# EasyEDA Pro project 嵌入式.eprj, board 5V电源板
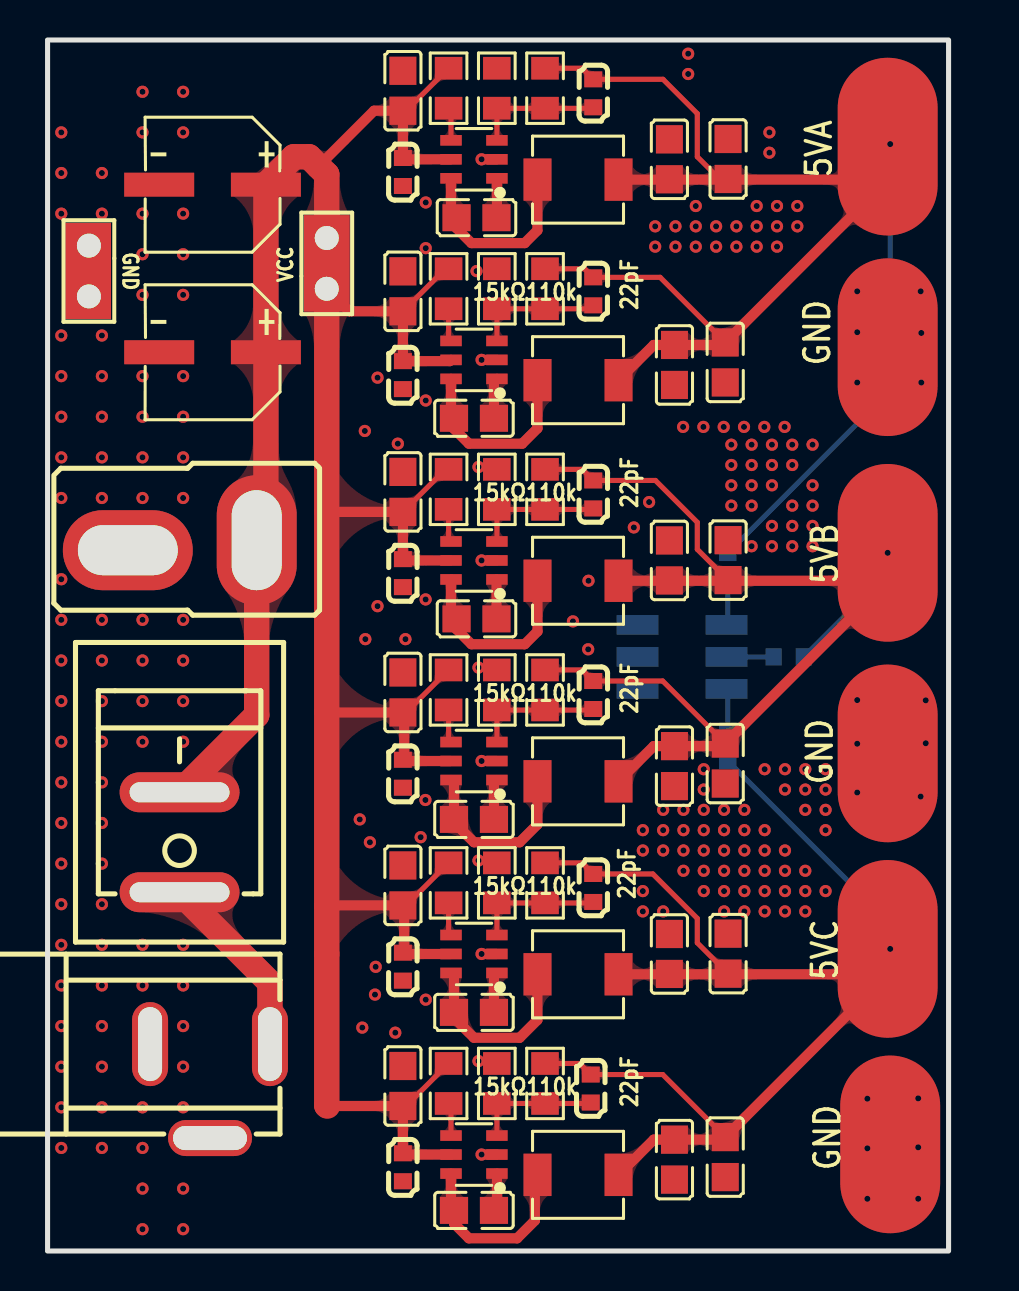
[diagram p12: board, top side]
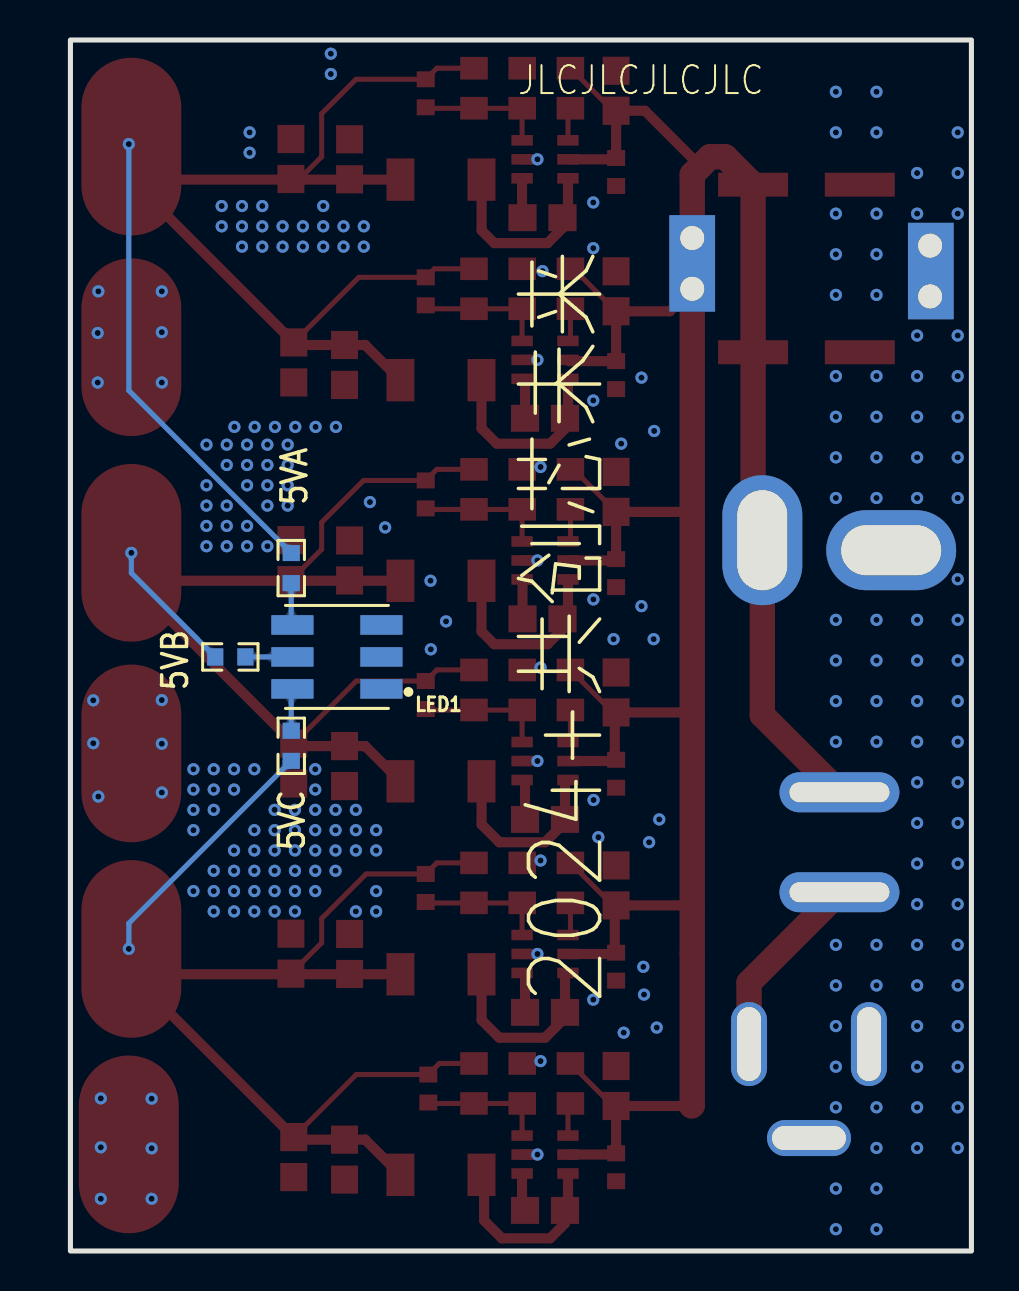
[diagram p13: board, bottom side, seen from below]

Outline 45.08 x 60.58 mm; copper layers: Top Layer, Bottom Layer. Coordinates in mm from the lower left corner of the outline.
Outline path: rectangle 0,60.58 45.08,0
Stack: Top Layer 0.035mm / Dielectric1 1.51mm FR4 er 4.5 / Bottom Layer 0.035mm

## Design rules (mm)
template: 自定义配置
spacing copperThickness1oz (default): track to track 0.102, other pairs 0.152 to 0.3
spacing copperThickness2oz: track to track 0.203, other pairs 0.152 to 0.3
track width copperThickness1oz (default): min 0.127, default 0.254, max 2.54
track width copperThickness2oz: min 0.203, default 0.254, max 2.54
differential pair differentialPair (default): width min 0.127, default 0.254, max 2.54; gap min 0.152, default 0.152
via viaSize (default): diameter min 0.5, default 0.61, max 10; hole min 0.3, default 0.305, max 6.3

## Placement (name value [footprint] x y rotation side)
C1  220uF  [CAP-SMD_BD6.3-L6.6-W6.6-FD]  8.26 44.96 180 top
C1#2  -  [CAP-SMD_BD6.3-L6.6-W6.6-FD]  8.26 53.34 180 top
C2  100nF  [C0603]  17.78 23.88 90 top
C2#2  -  [C0603]  17.78 33.91 90 top
C2#3  -  [C0603]  17.78 4.19 90 top
C2#4  -  [C0603]  17.78 14.22 90 top
C2#5  -  [C0603]  17.78 53.97 90 top
C2#6  -  [C0603]  17.78 43.81 90 top
C3  10uF  [C0805]  17.78 8.25 270 top
C3#2  -  [C0805]  17.78 27.94 270 top
C3#3  -  [C0805]  17.78 37.97 270 top
C3#4  -  [C0805]  17.78 18.29 270 top
C3#5  -  [C0805]  17.78 58.04 270 top
C3#6  -  [C0805]  17.78 48.01 270 top
C4  22uF  [C0805]  31.37 44.32 270 top
C4#2  -  [C0805]  31.37 24.26 270 top
C4#3  -  [C0805]  31.11 34.54 90 top
C4#4  -  [C0805]  31.11 54.61 90 top
C4#5  -  [C0805]  31.37 4.57 270 top
C4#6  -  [C0805]  31.11 14.86 90 top
C5  22uF  [C0805]  33.91 44.45 270 top
C5#2  -  [C0805]  33.91 24.38 270 top
C5#3  -  [C0805]  34.05 34.56 90 top
C5#4  -  [C0805]  34.05 54.63 90 top
C5#5  -  [C0805]  33.91 4.7 270 top
C5#6  -  [C0805]  34.05 14.87 90 top
C6  22pF  [C0603]  27.3 37.85 270 top
C6#2  -  [C0603]  27.3 27.81 270 top
C6#3  -  [C0603]  27.3 57.91 270 top
C6#4  -  [C0603]  27.18 8.13 270 top
C6#5  -  [C0603]  27.3 18.16 270 top
C6#6  -  [C0603]  27.3 48.01 270 top
C33  22nF  [C0805]  21.34 21.59 0 top
C33#2  -  [C0805]  21.46 31.62 0 top
C33#3  -  [C0805]  21.34 2.03 0 top
C33#4  -  [C0805]  21.34 11.94 0 top
C33#5  -  [C0805]  21.46 51.69 0 top
C33#6  -  [C0805]  21.34 41.66 0 top
CN1  AM-1015B-F  [CONN-TH_AM-1015B-F]  7.24 35.31 90 top
DC1  DC-005-2.5A-2.0  [CONN-TH_DC-005-2.5A-2.0]  8.13 8 0 top
H1  PZ254V-11-02P  [HDR-TH_2P-P2.54-V-M]  13.97 49.4 90 top
H1#2  -  [HDR-TH_2P-P2.54-V-M]  2.07 49.02 270 top
L1  4.7uH  [IND-SMD_L4.4-W4.2]  26.54 33.53 180 top
L1#2  -  [IND-SMD_L4.4-W4.2]  26.54 23.49 180 top
L1#3  -  [IND-SMD_L4.4-W4.2]  26.54 3.81 180 top
L1#4  -  [IND-SMD_L4.4-W4.2]  26.54 13.84 180 top
L1#5  -  [IND-SMD_L4.4-W4.2]  26.54 53.59 180 top
L1#6  -  [IND-SMD_L4.4-W4.2]  26.54 43.56 180 top
LED1  XL-5050RGBC  [LED-ARRAY-SMD_6P-L5.0-W5.0-TL-RD_3]  31.75 29.72 0 bottom
NOREF  -  [Pad_e655]  2.03 49.02 90 top
NOREF#2  -  [Pad_e166]  42.04 45.21 270 top
NOREF#3  -  [Pad_e651]  13.97 49.4 90 top
NOREF#4  -  [Pad_e168]  42.04 24.89 270 top
NOREF#5  -  [Pad_e169]  42.04 15.11 270 top
NOREF#6  -  [Pad_e170]  42.16 5.33 270 top
NOREF#7  -  [Pad_e654]  13.97 49.4 90 top
NOREF#8  -  [Pad_e167]  42.04 34.92 270 top
NOREF#9  -  [Pad_e164]  42.04 55.24 270 top
NOREF#10  -  [Pad_e653]  2.03 49.02 90 top
R1  0  [R0805]  20.07 38.1 270 top
R1#2  -  [R0805]  20.07 28.07 270 top
R1#3  -  [R0805]  20.07 18.41 270 top
R1#4  -  [R0805]  20.07 8.38 270 top
R1#5  -  [R0805]  20.07 58.17 270 top
R1#6  -  [R0805]  20.07 48.13 270 top
R2  15kΩ  [R0805]  22.48 58.17 90 top
R2#2  -  [R0805]  22.48 28.07 90 top
R2#3  -  [R0805]  22.48 38.1 90 top
R2#4  -  [R0805]  22.48 8.38 90 top
R2#5  -  [R0805]  22.48 18.41 90 top
R2#6  -  [R0805]  22.48 48.13 90 top
R3  110k  [R0805]  24.89 38.1 270 top
R3#2  -  [R0805]  24.89 58.17 270 top
R3#3  -  [R0805]  24.89 28.07 270 top
R3#4  -  [R0805]  24.89 8.38 270 top
R3#5  -  [R0805]  24.89 18.41 270 top
R3#6  -  [R0805]  24.89 48.13 270 top
R19  1kΩ  [R0603]  34.04 34.16 270 bottom
R20  1kΩ  [R0603]  37.08 29.72 180 bottom
R21  1kΩ  [R0603]  34.04 25.27 90 bottom
SW1  RS601HL-1010011BB  [SW-TH_RS601HL-1010011BB]  6.6 20.45 90 top
U1  MT2492  [SOT-23-6_L2.9-W1.6-P0.95-LS2.8-BL]  21.34 54.61 90 top
U1#2  -  [SOT-23-6_L2.9-W1.6-P0.95-LS2.8-BL]  21.34 24.51 90 top
U1#3  -  [SOT-23-6_L2.9-W1.6-P0.95-LS2.8-BL]  21.34 34.54 90 top
U1#4  -  [SOT-23-6_L2.9-W1.6-P0.95-LS2.8-BL]  21.34 4.83 90 top
U1#5  -  [SOT-23-6_L2.9-W1.6-P0.95-LS2.8-BL]  21.34 14.86 90 top
U1#6  -  [SOT-23-6_L2.9-W1.6-P0.95-LS2.8-BL]  21.34 44.58 90 top

## Footprints (pads in the part's own frame, mm; a bottom-side part is the same pattern mirrored in y, then rotated)
C0603
  rect 0.8x0.9 smd: 1(-0.7,0) 2(0.7,0)
C0805
  rect 1.41x1.35 smd: 1(-1,0) 2(1,0)
CAP-SMD_BD6.3-L6.6-W6.6-FD
  rect 3.5x1.2 smd: 1(-2.67,0) 2(2.67,0)
CONN-TH_AM-1015B-F
  oval 4x6.5 hole 2.5x5: 1(-0.25,3.224)
  oval 6.5x4 hole 5x2.5: 2(0.25,-3.224)
CONN-TH_DC-005-2.5A-2.0
  oval 1.8x4.2 hole 1.2x3.7: 1(2.999,2.35) 2(-2.999,2.35)
  oval 4.2x1.8 hole 3.7x1.2: 3(0,-2.35)
HDR-TH_2P-P2.54-V-M
  rect 2x2 hole 1.2: 1(-1.27,0)
  round 2 hole 1.2: 2(1.27,0)
IND-SMD_L4.4-W4.2
  rect 1.4x2.12 smd: 1(2.028,0) 2(-2.028,0)
LED-ARRAY-SMD_6P-L5.0-W5.0-TL-RD_3
  rect 2.105x0.98 smd: 1(-2.228,1.6) 2(-2.228,0) 3(-2.228,-1.6) 4(2.228,-1.6) 5(2.228,0) 6(2.228,1.6)
Pad_e164
  oval 8.89x5 smd: 7(0,0)
Pad_e166
  oval 8.89x5 smd: 7(0,0)
Pad_e167
  oval 8.89x5 smd: 7(0,0)
Pad_e168
  oval 8.89x5 smd: 7(0,0)
Pad_e169
  oval 8.89x5 smd: 7(0,0)
Pad_e170
  oval 8.89x5 smd: 7(0,0)
Pad_e651
  rect 4.826x2.286 smd: 7(0,0)
Pad_e653
  rect 4.826x2.286 smd: 7(0,0)
Pad_e654
  rect 4.826x2.286 smd far side: 7(0,0)
Pad_e655
  rect 4.826x2.286 smd far side: 7(0,0)
R0603
  rect 0.806x0.864 smd: 1(-0.753,0) 2(0.753,0)
R0805
  rect 1.133x1.377 smd: 1(-1,0) 2(1,0)
SOT-23-6_L2.9-W1.6-P0.95-LS2.8-BL
  rect 0.532x1.072 smd: 1(-0.95,-1.149) 2(0,-1.149) 3(0.95,-1.149) 4(0.95,1.149) 5(0,1.149) 6(-0.95,1.149)
SW-TH_RS601HL-1010011BB
  oval 2x6 hole 1x5: 1(-2.5,0) 2(2.5,0)

## Nets
5VA: C4.1 C4#2.1 C4#3.1 C4#4.1 C4#5.1 C4#6.1 C5.1 C5#2.1 C5#3.1 C5#4.1 C5#5.1 C5#6.1 C6.1 C6#2.1 C6#3.1 C6#4.1 C6#5.1 C6#6.1 L1.2 L1#2.2 L1#3.2 L1#4.2 L1#5.2 L1#6.2 NOREF#5.7 NOREF#8.7 NOREF#9.7 R3.1 R3#2.1 R3#3.1 R3#4.1 R3#5.1 R3#6.1 R19.1 R20.1 R21.1
GND: C1.2 C1#2.2 C2.1 C2#2.1 C2#3.1 C2#4.1 C2#5.1 C2#6.1 C3.1 C3#2.1 C3#3.1 C3#4.1 C3#5.1 C3#6.1 C4.2 C4#2.2 C4#3.2 C4#4.2 C4#5.2 C4#6.2 C5.2 C5#2.2 C5#3.2 C5#4.2 C5#5.2 C5#6.2 CN1.1 DC1.2 DC1.3 H1#2.1 H1#2.2 LED1.1 LED1.2 LED1.3 NOREF.7 NOREF#2.7 NOREF#4.7 NOREF#6.7 NOREF#10.7 R2.2 R2#2.2 R2#3.2 R2#4.2 R2#5.2 R2#6.2 U1.2 U1#2.2 U1#3.2 U1#4.2 U1#5.2 U1#6.2
VCC: C1.1 C1#2.1 C2.2 C2#2.2 C2#3.2 C2#4.2 C2#5.2 C2#6.2 C3.2 C3#2.2 C3#3.2 C3#4.2 C3#5.2 C3#6.2 CN1.2 H1.1 H1.2 NOREF#3.7 NOREF#7.7 R1.1 R1#2.1 R1#3.1 R1#4.1 R1#5.1 R1#6.1 SW1.2 U1.5 U1#2.5 U1#3.5 U1#4.5 U1#5.5 U1#6.5
PWER: DC1.1 SW1.1
$1N570: R1.2 R1#2.2 R1#3.2 R1#4.2 R1#5.2 R1#6.2 U1.4 U1#2.4 U1#3.4 U1#4.4 U1#5.4 U1#6.4
$1N904: C33.1 C33#2.1 C33#3.1 C33#4.1 C33#5.1 C33#6.1 L1.1 L1#2.1 L1#3.1 L1#4.1 L1#5.1 L1#6.1 U1.6 U1#2.6 U1#3.6 U1#4.6 U1#5.6 U1#6.6
$1N917: C33.2 C33#2.2 C33#3.2 C33#4.2 C33#5.2 C33#6.2 U1.1 U1#2.1 U1#3.1 U1#4.1 U1#5.1 U1#6.1
$1N1064: C6.2 C6#2.2 C6#3.2 C6#4.2 C6#5.2 C6#6.2 R2.1 R2#2.1 R2#3.1 R2#4.1 R2#5.1 R2#6.1 R3.2 R3#2.2 R3#3.2 R3#4.2 R3#5.2 R3#6.2 U1.3 U1#2.3 U1#3.3 U1#4.3 U1#5.3 U1#6.3
$1N4201: LED1.5 R20.2
$1N4240: LED1.6 R21.2
$1N4279: LED1.4 R19.2

## Via types
v1: diameter 0.61, hole 0.305, Top Layer to Bottom Layer, 246 vias

## Routing (per net, layer and track width the routed paths; a pad name or vN(x,y) marks a point on that pad's centre or on a via; arc(x,y) is an arc through that point)
5VA: length 211.6
  Top Layer w0.254: C5.1 30.65,48.71 C6#6.1 26.88,49.13 R3#6.1 ; R3#2.1 26.75,59.17 C6#3.1 30.8,58.61 32.51,56.9 32.51,54.74 33.62,53.63 C5#4.1 ; C5#2.1 30.78,28.51 C6#2.1 26.75,29.07 R3#3.1 ; C5#3.1 32.51,35.1 32.51,36.45 30.42,38.55 C6.1 26.75,39.1 R3.1 ; R3#4.1 26.62,9.38 C6#4.1 30.78,8.83 C5#5.1 ; C5#6.1 32.51,15.41 32.51,16.64 30.29,18.86 C6#5.1 26.75,19.41 R3#5.1
  Top Layer w0.508: 34.02,53.59 40.39,53.59 NOREF#9.7 42.04,53.58 C5.1 33.78,45.32 C4.1 30.33,45.32 L1#6.2 ; 34.02,53.59 C5#4.1 ; 34.02,53.59 L1#5.2 ; L1.2 40.64,33.53 v1(42.04,34.92) 42.04,33.51 C5#2.1 33.78,25.26 C4#2.1 30.33,25.26 L1#2.2 ; L1#3.2 30.33,5.57 C4#5.1 33.78,5.57 C5#5.1 42.04,13.83 NOREF#5.7 40.77,13.84 L1#4.2
  Bottom Layer w0.254: v1(42.16,55.37) 42.16,43.04 R19.1 ; v1(42.16,15.11) 42.16,16.39 R21.1 ; R20.1 42.04,33.92 42.04,34.8
GND: length 4.6
  Top Layer w0.508: 22.48,14.86 v1(21.72,14.86) ; 22.48,24.51 v1(21.72,24.51) ; U1#3.2 v1(21.72,34.54) ; U1#4.2 v1(21.72,4.83) ; U1#6.2 v1(21.72,44.58) ; U1.2 v1(21.72,54.61)
  vias: v1(0.69,55.96) v1(0.69,53.92) v1(0.69,51.89) v1(0.69,45.8) v1(0.69,43.76) v1(0.69,41.73) v1(0.69,39.7) v1(0.69,37.67) v1(0.69,33.6) v1(0.69,31.57) v1(0.69,29.54) v1(0.69,27.51) v1(0.69,25.48) v1(0.69,23.44) v1(0.69,21.41) v1(0.69,19.38) v1(0.69,17.35) v1(0.69,15.32) v1(0.69,13.28) v1(0.69,11.25) v1(0.69,9.22) v1(0.69,7.19) v1(0.69,5.16) v1(2.72,53.92) v1(2.72,51.89) v1(2.72,45.8) v1(2.72,43.76) v1(2.72,41.73) v1(2.72,39.7) v1(2.72,37.67) v1(2.72,31.57) v1(2.72,29.54) v1(2.72,27.51) v1(2.72,25.48) v1(2.72,23.44) v1(2.72,21.41) v1(2.72,19.38) v1(2.72,17.35) v1(2.72,15.32) v1(2.72,13.28) v1(2.72,11.25) v1(2.72,9.22) v1(2.72,7.19) v1(2.72,5.16) v1(4.75,57.99) v1(4.75,55.96) v1(4.75,51.89) v1(4.75,49.86) v1(4.75,47.83) v1(4.75,43.76) v1(4.75,41.73) v1(4.75,39.7) v1(4.75,37.67) v1(4.75,31.57) v1(4.75,29.54) v1(4.75,27.51) v1(4.75,25.48) v1(4.75,15.32) v1(4.75,13.28) v1(4.75,7.19) v1(4.75,5.16) v1(4.75,3.12) v1(4.75,1.09) v1(6.78,57.99) v1(6.78,55.96) v1(6.78,51.89) v1(6.78,49.86) v1(6.78,47.83) v1(6.78,43.76) v1(6.78,41.73) v1(6.78,39.7) v1(6.78,37.67) v1(6.78,31.57) v1(6.78,29.54) v1(6.78,27.51) v1(6.78,25.48) v1(6.78,15.32) v1(6.78,13.28) v1(6.78,11.25) v1(6.78,9.22) v1(6.78,7.19) v1(6.78,3.12) v1(6.78,1.09) v1(15.62,21.59) v1(15.75,11.18) v1(15.88,41.02) v1(15.9,30.61) v1(16.13,20.45) v1(16.42,14.22) v1(16.38,12.83) v1(16.51,43.69) v1(16.51,32.26) v1(17.4,10.92) v1(17.53,40.39) v1(17.91,30.61) v1(18.67,20.7) v1(18.92,52.45) v1(18.92,50.16) v1(18.92,42.54) v1(18.92,32.59) v1(18.91,22.56) v1(18.92,12.57) v1(21.46,49.02) v1(21.56,39.22) v1(21.56,29.19) v1(21.56,19.53) v1(21.56,9.5) v1(26.29,31.5) v1(27.07,33.53) v1(27.05,30.1) v1(29.34,36.19) v1(29.79,21.05) v1(29.79,20.04) v1(29.79,18) v1(29.79,16.99) v1(30.1,37.46) v1(30.4,51.26) v1(30.4,50.24) v1(30.8,22.07) v1(30.8,21.05) v1(30.8,20.04) v1(30.8,16.99) v1(31.42,51.26) v1(31.42,50.24) v1(31.8,41.22) v1(31.82,22.07) v1(31.82,21.05) v1(31.82,20.04) v1(31.82,19.02) v1(32.05,59.89) v1(32.05,58.88) v1(32.44,52.27) v1(32.44,51.26) v1(32.44,50.24) v1(32.82,41.22) v1(32.83,24.1) v1(32.83,23.08) v1(32.83,22.07) v1(32.83,21.05) v1(32.83,20.04) v1(32.83,19.02) v1(32.83,18) v1(33.45,51.26) v1(33.45,50.24) v1(33.83,41.22) v1(33.85,22.07) v1(33.85,21.05) v1(33.85,20.04) v1(33.85,19.02) v1(33.85,18) v1(33.85,16.99) v1(34.21,40.33) v1(34.21,39.32) v1(34.21,38.3) v1(34.21,37.29) v1(34.47,51.26) v1(34.47,50.24) v1(34.85,41.22) v1(34.87,22.07) v1(34.87,21.05) v1(34.87,20.04) v1(34.87,19.02) v1(34.87,18) v1(34.87,16.99) v1(35.23,40.33) v1(35.23,39.32) v1(35.23,38.3) v1(35.23,37.29) v1(35.23,35.25) v1(35.48,52.27) v1(35.48,51.26) v1(35.48,50.24) v1(35.86,41.22) v1(35.88,24.1) v1(35.88,21.05) v1(35.88,20.04) v1(35.88,19.02) v1(35.88,18) v1(35.88,16.99) v1(36.12,55.96) v1(36.12,54.94) v1(36.25,40.33) v1(36.25,39.32) v1(36.25,38.3) v1(36.25,36.27) v1(36.25,35.25) v1(36.5,52.27) v1(36.5,51.26) v1(36.5,50.24) v1(36.88,41.22) v1(36.9,24.1) v1(36.9,23.08) v1(36.9,20.04) v1(36.9,19.02) v1(36.9,18) v1(36.9,16.99) v1(37.26,40.33) v1(37.26,39.32) v1(37.26,37.29) v1(37.26,36.27) v1(37.26,35.25) v1(37.52,52.27) v1(37.52,51.26) v1(37.91,24.1) v1(37.91,23.08) v1(37.91,22.07) v1(37.91,19.02) v1(37.91,18) v1(37.91,16.99) v1(38.28,40.33) v1(38.28,38.3) v1(38.28,37.29) v1(38.28,36.27) v1(38.28,35.25) v1(38.93,24.1) v1(38.93,23.08) v1(38.93,22.07) v1(38.93,21.05) v1(38.93,18) v1(40.51,48.01) v1(40.51,45.96) v1(40.51,43.44) v1(40.51,27.56) v1(40.51,25.37) v1(40.51,22.93) v1(41.02,7.62) v1(41.02,5.14) v1(41.02,2.61) v1(43.57,7.63) v1(43.57,5.19) v1(43.57,2.61) v1(43.69,48.01) v1(43.72,45.92) v1(43.72,43.44) v1(43.69,22.73) v1(43.94,27.55) v1(43.94,25.4)
VCC: length 155.8
  Top Layer w0.254: C3#5.2 17.94,57.04 R1#5.1 ; R1#3.1 17.94,17.29 C3#4.2 ; R1#6.1 19.91,49.13 C3#6.2 ; C3.2 17.94,7.25 R1#4.1 ; R1.1 19.91,39.1 C3#3.2 ; C3#2.2 17.94,26.94 R1#2.1
  Top Layer w0.508: 14,7.25 C3.2 C2#3.2 17.85,4.83 U1#4.5 ; 17.85,14.86 C2#4.2 ; 17.85,14.86 U1#5.5 ; 17.85,14.86 17.85,17.22 C3#4.2 14,17.29 13.97,17.26 ; 13.98,14.86 13.97,14.86 ; 13.97,36.96 13.99,36.97 C3#3.2 C2#2.2 17.85,34.54 U1#3.5 ; U1#2.5 17.85,24.51 ; 17.85,24.51 17.85,26.87 C3#2.2 13.98,26.94 13.97,26.95 ; 17.85,24.51 C2.2 ; U1.5 17.85,54.61 C2#5.2 C3#5.2 16.33,57.04 13.56,54.26 ; U1#6.5 20.13,44.51 C2#6.2 C3#6.2 15.1,47.01 H1.1
  Top Layer w1.27: SW1.2 10.46,26.81 CN1.2 10.46,36.33 10.92,36.79 C1.1 C1#2.1 12.32,54.74 13.08,54.74 13.97,53.85 H1.2 H1.1 13.97,7.29 14,7.25
PWER: length 9.5
  Top Layer w1.27: SW1.1 11.13,13.42 DC1.1
$1N570: length 9.9
  Top Layer w0.254: U1#2.4 20.07,25.58 R1#2.2 ; U1#3.4 20.07,35.61 R1.2 ; U1#4.4 20.19,7.26 R1#4.2 ; R1#6.2 20.07,45.65 U1#6.4 ; U1#5.4 20.07,15.93 R1#3.2 ; R1#5.2 20.19,57.04 U1.4
$1N904: length 57.8
  Top Layer w0.508: L1#3.1 24.38,3.68 24.38,1.52 23.5,0.63 21.08,0.63 20.34,1.38 20.34,1.91 20.19,2.05 U1#4.6 ; U1.6 20.19,51.96 C33#5.1 20.46,51.16 21.21,50.42 23.88,50.42 24.51,51.05 24.51,53.59 L1#5.1 ; L1#6.1 24.52,41.15 23.75,40.39 21.08,40.39 20.34,41.13 C33#6.1 20.19,41.8 U1#6.6 ; L1.1 24.52,30.99 23.88,30.35 21.21,30.35 20.46,31.1 C33#2.1 20.19,31.9 U1#3.6 ; U1#2.6 20.34,23.41 C33.1 20.34,21.45 21.34,20.45 23.62,20.45 24.51,21.34 24.51,23.49 L1#2.1 ; L1#4.1 24.51,13.84 24.51,11.56 23.62,10.67 21.34,10.67 20.34,11.67 C33#4.1 20.34,13.76 U1#5.6
$1N917: length 12
  Top Layer w0.508: C33.2 22.34,23.41 U1#2.1 ; U1#5.1 22.34,13.76 C33#4.2 ; C33#3.2 22.48,2.18 U1#4.1 ; U1#3.1 22.46,33.57 C33#2.2 ; U1#6.1 22.34,43.48 C33#6.2 ; U1.1 22.48,51.71 C33#5.2
$1N1064: length 38.9
  Top Layer w0.254: U1#6.3 22.48,47.13 R2#6.1 R3#6.2 27.13,47.13 C6#6.2 ; U1#4.3 22.48,7.38 R2#4.1 R3#4.2 27.13,7.38 27.3,7.55 ; 27.3,37.27 27.13,37.09 22.48,37.09 ; U1#3.3 22.48,37.09 ; 22.48,37.09 R2#3.1 ; U1.3 22.48,57.16 27.13,57.16 27.3,57.34 ; 22.48,27.06 27.25,27.06 C6#2.2 ; 22.48,27.06 U1#2.3 ; 22.48,27.06 R2#2.1 ; 22.48,17.41 R2#5.1 ; 22.48,17.41 27.25,17.41 C6#5.2 ; 22.48,17.41 U1#5.3
  Top Layer w0.508: 22.48,57.16 R2.1
$1N4201: length 2.4
  Bottom Layer w0.254: R20.2 LED1.5
$1N4240: length 2.1
  Bottom Layer w0.254: LED1.6 34.04,28.06 R21.2
$1N4279: length 2.1
  Bottom Layer w0.254: R19.2 34.04,31.38 LED1.4

## Copper pours and planes (outline as drawn; the poured copper is in the pictures)
GND on Top Layer: 0,60.58 45.08,60.58 45.08,0 0,0
GND on Bottom Layer: 0,60.58 45.08,60.58 45.08,0 0,0

Small or netless copper shapes (teardrops, artwork), in the pictures only: 228 on Top Layer, 12 on Bottom Layer

## Text on the board
Bottom Silkscreen Layer: 5VA | 5VC | 5VB | JLCJLCJLCJLC | 2024+共创芯未来
Top Silkscreen Layer: VCC | GND | 15kΩ | 110k | 22pF | 5VA | 5VB | 5VC
